# Altium schematic sheet 0228_GPU DDI_ A,B,C,D.SchDoc (continued)
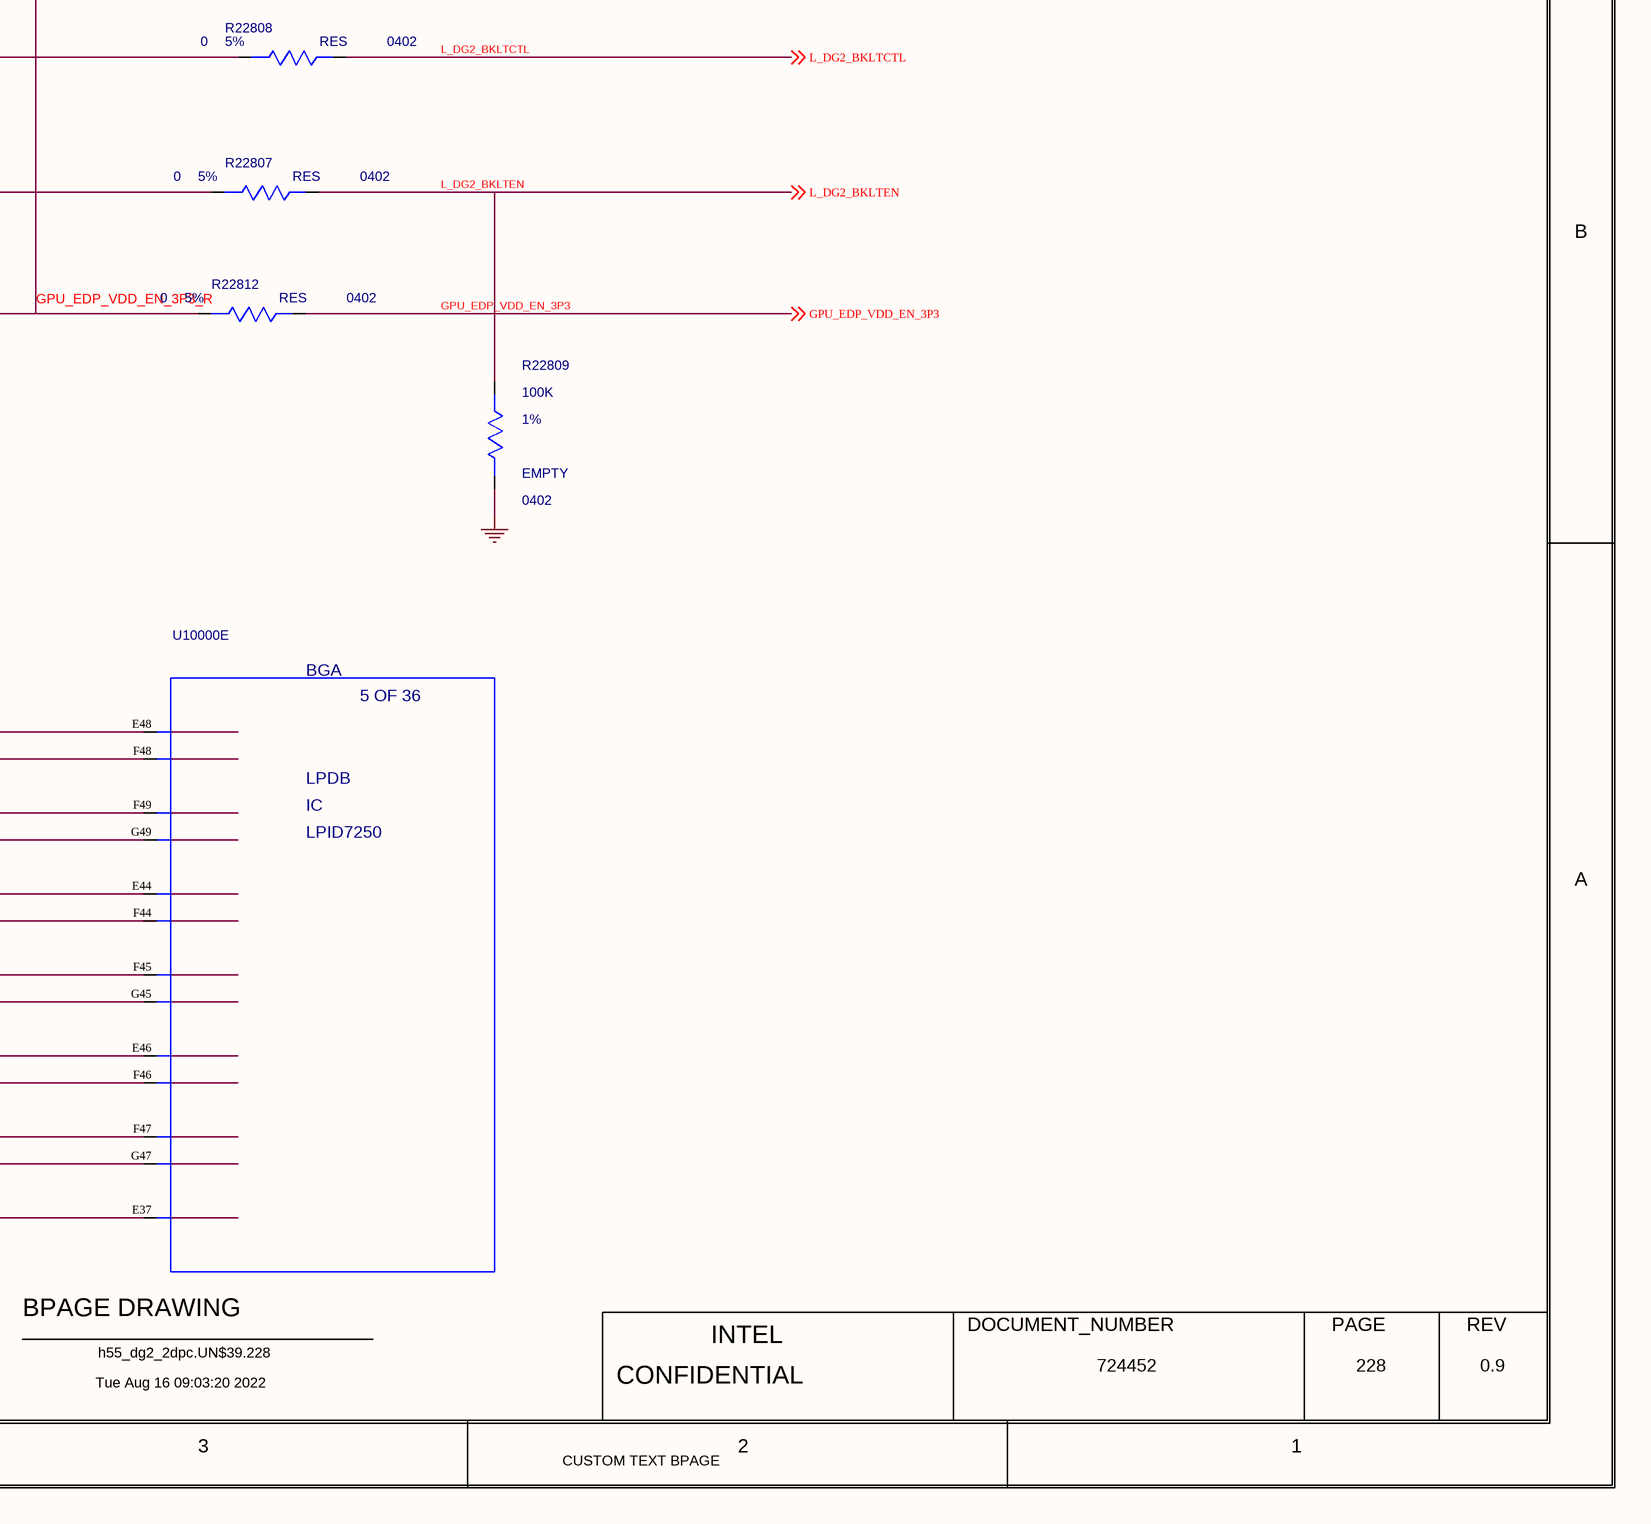
[diagram p5: 0228_GPU DDI_ A,B,C,D.SchDoc, bottom right]

## Parts
C22801  0.1uF  MATERIAL: EMPTY  PACK_TYPE: 0402  TOLERANCE: 10%  VOLTAGE: 25V  [CTK2_SM0402_1050X550_MA]
C22802  0.1uF  MATERIAL: EMPTY  PACK_TYPE: 0402  TOLERANCE: 10%  VOLTAGE: 25V  [CTK2_SM0402_1050X550_MA]
C22805  0.1uF  MATERIAL: EMPTY  PACK_TYPE: 0402  TOLERANCE: 10%  VOLTAGE: 25V  [CTK2_SM0402_1050X550_MA]
Q22801  RV1C002UNT2CL  PART_NUMBER: H76653-001  [CTK2_LCC3_850X650_350_MA]
Q22802  RV1C002UNT2CL  PART_NUMBER: H76653-001  [CTK2_LCC3_850X650_350_MA]
Q22803  RV1C002UNT2CL  PART_NUMBER: H76653-001  [CTK2_LCC3_850X650_350_MA]
R22802  2.2K  MATERIAL: CHIP  PACK_TYPE: 0402  PART_NUMBER: A93549-017  TOLERANCE: 5%  [SMR0402IA]
R22803  2.2K  MATERIAL: CHIP  PACK_TYPE: 0402  TOLERANCE: 5%  [SMR0402IA]
R22807  0  MATERIAL: RES  PACK_TYPE: 0402  TOLERANCE: 5%  [CTK2_SM0402_1100X550_MA]
R22808  0  MATERIAL: RES  PACK_TYPE: 0402  TOLERANCE: 5%  [CTK2_SM0402_1100X550_MA]
R22809  100K  MATERIAL: EMPTY  PACK_TYPE: 0402  TOLERANCE: 1%  [CTK2_SM0402_1100X550_MA]
R22810  2.2K  MATERIAL: CHIP  PACK_TYPE: 0402  TOLERANCE: 5%  [SMR0402IA]
R22811  2.2K  MATERIAL: CHIP  PACK_TYPE: 0402  TOLERANCE: 5%  [SMR0402IA]
R22812  0  MATERIAL: RES  PACK_TYPE: 0402  TOLERANCE: 5%  [CTK2_SM0402_1100X550_MA]
R22813  0  MATERIAL: RES  PACK_TYPE: 0402  TOLERANCE: 5%  [CTK2_SM0402_1100X550_MA]
R22814  0  MATERIAL: RES  PACK_TYPE: 0402  TOLERANCE: 5%  [CTK2_SM0402_1100X550_MA]
R22815  0  MATERIAL: RES  PACK_TYPE: 0402  TOLERANCE: 5%  [CTK2_SM0402_1100X550_MA]
R22816  0  MATERIAL: RES  PACK_TYPE: 0402  PART_NUMBER: A93549-001  TOLERANCE: 5%  WATTAGE: 0.0625W  [CTK2_SM0402_1100X550_MA]
R22817  2.2K  MATERIAL: CHIP  PACK_TYPE: 0402  TOLERANCE: 5%  [SMR0402IA]
R22818  2.2K  MATERIAL: CHIP  PACK_TYPE: 0402  TOLERANCE: 5%  [SMR0402IA]
R22819  0  MATERIAL: EMPTY  PACK_TYPE: 0402  PART_NUMBER: H75801-001  TOLERANCE: 5%  WATTAGE: 0.0625W  [CTK2_SM0402_1100X550_MA]
R22820  0  MATERIAL: RES  PACK_TYPE: 0402  PART_NUMBER: A93549-001  TOLERANCE: 5%  WATTAGE: 0.0625W  [CTK2_SM0402_1100X550_MA]
U10000  PART_NUMBER: LPID7250  PACK_TYPE: BGA  MATERIAL: IC  FP_TECH: LPDB  [CLPDB_BGA2660_DG2_SVC_512_LP7250_MA]  (hidden comment: DG2_IP_NB_SKU1_SKU2_SKU3_EXT)  (parts B,C,D,E of 36)

## Nets
+V1P8S_GPU: R22802.1(A) R22803.1(A) R22816.1(A) R22818.1(A)
+V3P3A: R22820.1(A)
+V3P3S: R22819.1(A)
GND: C22801.2(B) C22802.2(B) C22805.2(B) R22809.2(B)
DDIB_AUX_DN_NC: U10000.J51(DDIB_AUX_N)
DDIB_AUX_DP_NC: U10000.J52(DDIB_AUX_P)
DDID_I2C_CLK_NC: U10000.F49(DDCD_SCL)
DDID_I2C_DAT_NC: U10000.G49(DDCD_SDA)
EDP_BKLT_CTRL_LS_R: Q22803.3(D) R22808.1(A) R22810.2(B)
EDP_BKLT_EN_LS_R: Q22802.3(D) R22807.1(A) R22811.2(B)
EDP_DG2_AUX_DN: U10000.K56(DDIA_AUX_N) ; off-sheet EDP_DG2_AUX_DN
EDP_DG2_AUX_DP: U10000.K57(DDIA_AUX_P) ; off-sheet EDP_DG2_AUX_DP
EDP_DG2_TX0_DN: U10000.J55(DDIA_TXN0) ; off-sheet EDP_DG2_TX0_DN
EDP_DG2_TX0_DP: U10000.J56(DDIA_TXP0) ; off-sheet EDP_DG2_TX0_DP
EDP_DG2_TX1_DN: U10000.H56(DDIA_TXN1) ; off-sheet EDP_DG2_TX1_DN
EDP_DG2_TX1_DP: U10000.H57(DDIA_TXP1) ; off-sheet EDP_DG2_TX1_DP
EDP_DG2_TX2_DN: U10000.G55(DDIA_TXN2) ; off-sheet EDP_DG2_TX2_DN
EDP_DG2_TX2_DP: U10000.G56(DDIA_TXP2) ; off-sheet EDP_DG2_TX2_DP
EDP_DG2_TX3_DN: U10000.F56(DDIA_TXN3) ; off-sheet EDP_DG2_TX3_DN
EDP_DG2_TX3_DP: U10000.F57(DDIA_TXP3) ; off-sheet EDP_DG2_TX3_DP
GPU_DDIA_I2C_CLK_NC: U10000.E56(DDCA_SCL)
GPU_DDIA_I2C_DAT_NC: U10000.E55(DDCA_SDA)
GPU_DDIB_DP_HPDB_N: U10000.B37(DP_HPDB#) ; off-sheet GPU_DDIB_DP_HPDB_N
GPU_DDIB_LANE0_DN: U10000.H52(DDIB_TXN0) ; off-sheet GPU_DDIB_LANE0_DN
GPU_DDIB_LANE0_DP: U10000.H53(DDIB_TXP0) ; off-sheet GPU_DDIB_LANE0_DP
GPU_DDIB_LANE1_DN: U10000.G51(DDIB_TXN1) ; off-sheet GPU_DDIB_LANE1_DN
GPU_DDIB_LANE1_DP: U10000.G52(DDIB_TXP1) ; off-sheet GPU_DDIB_LANE1_DP
GPU_DDIB_LANE2_DN: U10000.F52(DDIB_TXN2) ; off-sheet GPU_DDIB_LANE2_DN
GPU_DDIB_LANE2_DP: U10000.F53(DDIB_TXP2) ; off-sheet GPU_DDIB_LANE2_DP
GPU_DDIB_LANE3_DN: U10000.E51(DDIB_TXN3) ; off-sheet GPU_DDIB_LANE3_DN
GPU_DDIB_LANE3_DP: U10000.E52(DDIB_TXP3) ; off-sheet GPU_DDIB_LANE3_DP
GPU_DDIB_SCL: U10000.K52(DDCB_SCL) ; off-sheet GPU_DDIB_SCL
GPU_DDIB_SDA: U10000.K53(DDCB_SDA) ; off-sheet GPU_DDIB_SDA
GPU_DDIC_DP_HPD_N: U10000.C37(DP_HPDC#) ; off-sheet GPU_DDIC_DP_HPD_N
GPU_DDIC_DPIN2_AUX_DN: U10000.B53(DDIC_AUX_N) ; off-sheet GPU_DDIC_DPIN2_AUX_DN
GPU_DDIC_DPIN2_AUX_DP: U10000.A53(DDIC_AUX_P) ; off-sheet GPU_DDIC_DPIN2_AUX_DP
GPU_DDIC_DPIN2_LANE0_DN: U10000.C52(DDIC_TXN0) ; off-sheet GPU_DDIC_DPIN2_LANE0_DN
GPU_DDIC_DPIN2_LANE0_DP: U10000.B52(DDIC_TXP0) ; off-sheet GPU_DDIC_DPIN2_LANE0_DP
GPU_DDIC_DPIN2_LANE1_DN: U10000.B51(DDIC_TXN1) ; off-sheet GPU_DDIC_DPIN2_LANE1_DN
GPU_DDIC_DPIN2_LANE1_DP: U10000.A51(DDIC_TXP1) ; off-sheet GPU_DDIC_DPIN2_LANE1_DP
GPU_DDIC_DPIN2_LANE2_DN: U10000.C50(DDIC_TXN2) ; off-sheet GPU_DDIC_DPIN2_LANE2_DN
GPU_DDIC_DPIN2_LANE2_DP: U10000.B50(DDIC_TXP2) ; off-sheet GPU_DDIC_DPIN2_LANE2_DP
GPU_DDIC_DPIN2_LANE3_DN: U10000.B49(DDIC_TXN3) ; off-sheet GPU_DDIC_DPIN2_LANE3_DN
GPU_DDIC_DPIN2_LANE3_DP: U10000.A49(DDIC_TXP3) ; off-sheet GPU_DDIC_DPIN2_LANE3_DP
GPU_DDIC_I2C_CLK_NC: U10000.B48(DDCC_SCL)
GPU_DDIC_I2C_DAT_NC: U10000.C48(DDCC_SDA)
GPU_DDID_DP_HPD_N: U10000.E37(DP_HPDD#) ; off-sheet GPU_DDID_DP_HPD_N
GPU_DDID_DPIN1_AUX_DN: U10000.F48(DDID_AUX_N) ; off-sheet GPU_DDID_DPIN1_AUX_DN
GPU_DDID_DPIN1_AUX_DP: U10000.E48(DDID_AUX_P) ; off-sheet GPU_DDID_DPIN1_AUX_DP
GPU_DDID_DPIN1_LANE0_DN: U10000.G47(DDID_TXN0) ; off-sheet GPU_DDID_DPIN1_LANE0_DN
GPU_DDID_DPIN1_LANE0_DP: U10000.F47(DDID_TXP0) ; off-sheet GPU_DDID_DPIN1_LANE0_DP
GPU_DDID_DPIN1_LANE1_DN: U10000.F46(DDID_TXN1) ; off-sheet GPU_DDID_DPIN1_LANE1_DN
GPU_DDID_DPIN1_LANE1_DP: U10000.E46(DDID_TXP1) ; off-sheet GPU_DDID_DPIN1_LANE1_DP
GPU_DDID_DPIN1_LANE2_DN: U10000.G45(DDID_TXN2) ; off-sheet GPU_DDID_DPIN1_LANE2_DN
GPU_DDID_DPIN1_LANE2_DP: U10000.F45(DDID_TXP2) ; off-sheet GPU_DDID_DPIN1_LANE2_DP
GPU_DDID_DPIN1_LANE3_DN: U10000.F44(DDID_TXN3) ; off-sheet GPU_DDID_DPIN1_LANE3_DN
GPU_DDID_DPIN1_LANE3_DP: U10000.E44(DDID_TXP3) ; off-sheet GPU_DDID_DPIN1_LANE3_DP
GPU_DISP_UTILS0_NC: U10000.G38(DISP_UTILS0)
GPU_DISP_UTILS1_NC: U10000.H38(DISP_UTILS1)
GPU_EDP_BKLT_CNTRL_FET: Q22801.1(G) Q22802.1(G) Q22803.1(G) R22816.2(B)
GPU_EDP_BKLT_CTRL: C22801.1(A) R22802.2(B) R22814.1(A) ; off-sheet GPU_EDP_BKLT_CTRL
GPU_EDP_BKLT_CTRL_R: Q22803.2(S) R22814.2(B)
GPU_EDP_BKLT_EN: C22802.1(A) R22803.2(B) R22815.1(A) ; off-sheet GPU_EDP_BKLT_EN
GPU_EDP_BKLT_EN_R: Q22802.2(S) R22815.2(B)
GPU_EDP_HPD: U10000.A37(DP_HPDA#) ; off-sheet GPU_EDP_HPD
GPU_EDP_VDD_EN: C22805.1(A) R22813.1(A) R22818.2(B) ; off-sheet GPU_EDP_VDD_EN
GPU_EDP_VDD_EN_3P3: R22812.2(B) ; off-sheet GPU_EDP_VDD_EN_3P3
GPU_EDP_VDD_EN_3P3_R: Q22801.3(D) R22812.1(A) R22817.2(B)
GPU_EDP_VDD_EN_R: Q22801.2(S) R22813.2(B)
L_DG2_BKLTCTL: R22808.2(B) ; off-sheet L_DG2_BKLTCTL
L_DG2_BKLTEN: R22807.2(B) R22809.1(A) ; off-sheet L_DG2_BKLTEN
UNNAMED_399_RES_I467_A: R22810.1(A) R22811.1(A) R22817.1(A) R22819.2(B) R22820.2(B)

Not connected (* = marked no-connect by the designer): U10000 F39(PANEL_VDDEN) G39(PANEL_BKLTCTL) H39(PANEL_BKLTEN)

## Notes on the sheet
- <XR_PAGE_TITLE>
- 8
- 7
- 6
- 5
- 4
- 3
- 2
- 1
- MODULE REV DETAILS
- GPU DDI: A,B,C,D
- MODULE NAME
- REV
- DATE
- D
- C
- B
- A
- BPAGE DRAWING
- INTEL
- DOCUMENT_NUMBER
- PAGE
- Tue Aug 16 09:03:20 2022
- h55_dg2_2dpc.UN$39.228
- CONFIDENTIAL
- 724452
- 228
- 0.9
- CUSTOM TEXT BPAGE
- (in symbol DG2_IP_NB_SKU1_SKU2_SKU3_EXT, part B) 2 OF 36
- (in symbol DG2_IP_NB_SKU1_SKU2_SKU3_EXT, part C) 3 OF 36
- (in symbol DG2_IP_NB_SKU1_SKU2_SKU3_EXT, part D) 4 OF 36
- (in symbol DG2_IP_NB_SKU1_SKU2_SKU3_EXT, part E) 5 OF 36

## Library data of the parts
C22801 = C_CAP: PART_NUMBER: G27060-002; CDS_PHYS_PART_NAME: C_CAP_0402-G27060-002,EMPTY,0.1UF,25V,10%,TK2,GENERIC; CDS_LMAN_SYM_OUTLINE: -50,50,50,-50; FP_TECH: TK2; IP: GENERIC; ROOM: NONE; OriginalSymbolOrigin: (-50,25); XY: (3650,1950); VER: 1; ROT: 0; PHYS_PAGE: 228; LOCATION: C22801; DRAWING: @RVP1_ADL_SB_ADP_S_DDR5_SODIMM_2DPC_LIB.H55_DG2_2DPC(SCH_1):PAGE399; CDS_LIB: c_discrete; VARIANT: ?; PCB Footprint: CTK2_SM0402_1050X550_MA; CHIPS_PART_NAME: C_CAP; CDS_PART_NAME: C_CAP_0402-G27060-002,EMPTY,0.1UF,25V,10%,TK2,GENERIC; CDS_LOCATION: C22801
C22802 = C_CAP: PART_NUMBER: G27060-002; CDS_PHYS_PART_NAME: C_CAP_0402-G27060-002,EMPTY,0.1UF,25V,10%,TK2,GENERIC; CDS_LMAN_SYM_OUTLINE: -50,50,50,-50; FP_TECH: TK2; IP: GENERIC; ROOM: NONE; OriginalSymbolOrigin: (-50,25); XY: (3925,1925); VER: 1; ROT: 0; PHYS_PAGE: 228; LOCATION: C22802; DRAWING: @RVP1_ADL_SB_ADP_S_DDR5_SODIMM_2DPC_LIB.H55_DG2_2DPC(SCH_1):PAGE399; CDS_LIB: c_discrete; VARIANT: ?; PCB Footprint: CTK2_SM0402_1050X550_MA; CHIPS_PART_NAME: C_CAP; CDS_PART_NAME: C_CAP_0402-G27060-002,EMPTY,0.1UF,25V,10%,TK2,GENERIC; CDS_LOCATION: C22802
C22805 = C_CAP: PART_NUMBER: G27060-002; CDS_PHYS_PART_NAME: C_CAP_0402-G27060-002,EMPTY,0.1UF,25V,10%,TK2,GENERIC; CDS_LMAN_SYM_OUTLINE: -50,50,50,-50; FP_TECH: TK2; IP: GENERIC; ROOM: NONE; OriginalSymbolOrigin: (-50,25); XY: (4250,1925); VER: 1; ROT: 0; PHYS_PAGE: 228; LOCATION: C22805; DRAWING: @RVP1_ADL_SB_ADP_S_DDR5_SODIMM_2DPC_LIB.H55_DG2_2DPC(SCH_1):PAGE399; CDS_LIB: c_discrete; VARIANT: ?; PCB Footprint: CTK2_SM0402_1050X550_MA; CHIPS_PART_NAME: C_CAP; CDS_PART_NAME: C_CAP_0402-G27060-002,EMPTY,0.1UF,25V,10%,TK2,GENERIC; CDS_LOCATION: C22805
Q22801 = C_MOSFET_N_ESD: CDS_PHYS_PART_NAME: C_MOSFET_N_ESD_LCC-H76653-001,MFET,RV1C002UNT2CL,TK2,GENERIC; CDS_LMAN_SYM_OUTLINE: -150,150,150,-150; FP_TECH: TK2; IP: GENERIC; MATERIAL: MFET; PACK_TYPE: LCC; ROOM: NONE; OriginalSymbolOrigin: (-150,150); XY: (5800,2150); VER: 1; ROT: 5; PHYS_PAGE: 228; LOCATION: Q22801; DRAWING: @RVP1_ADL_SB_ADP_S_DDR5_SODIMM_2DPC_LIB.H55_DG2_2DPC(SCH_1):PAGE399; CDS_LIB: local; VARIANT: ?; PCB Footprint: CTK2_LCC3_850X650_350_MA; CHIPS_PART_NAME: C_MOSFET_N_ESD; CDS_PART_NAME: C_MOSFET_N_ESD_LCC-H76653-001,MFET,RV1C002UNT2CL,TK2,GENERIC; CDS_LOCATION: Q22801
Q22802 = C_MOSFET_N_ESD: CDS_PHYS_PART_NAME: C_MOSFET_N_ESD_LCC-H76653-001,MFET,RV1C002UNT2CL,TK2,GENERIC; CDS_LMAN_SYM_OUTLINE: -150,150,150,-150; FP_TECH: TK2; IP: GENERIC; MATERIAL: MFET; PACK_TYPE: LCC; ROOM: NONE; OriginalSymbolOrigin: (-150,150); XY: (6000,2375); VER: 1; ROT: 5; PHYS_PAGE: 228; LOCATION: Q22802; DRAWING: @RVP1_ADL_SB_ADP_S_DDR5_SODIMM_2DPC_LIB.H55_DG2_2DPC(SCH_1):PAGE399; CDS_LIB: local; VARIANT: ?; PCB Footprint: CTK2_LCC3_850X650_350_MA; CHIPS_PART_NAME: C_MOSFET_N_ESD; CDS_PART_NAME: C_MOSFET_N_ESD_LCC-H76653-001,MFET,RV1C002UNT2CL,TK2,GENERIC; CDS_LOCATION: Q22802
Q22803 = C_MOSFET_N_ESD: CDS_PHYS_PART_NAME: C_MOSFET_N_ESD_LCC-H76653-001,MFET,RV1C002UNT2CL,TK2,GENERIC; CDS_LMAN_SYM_OUTLINE: -150,150,150,-150; FP_TECH: TK2; IP: GENERIC; MATERIAL: MFET; PACK_TYPE: LCC; ROOM: NONE; OriginalSymbolOrigin: (-150,150); XY: (6175,2625); VER: 1; ROT: 5; PHYS_PAGE: 228; LOCATION: Q22803; DRAWING: @RVP1_ADL_SB_ADP_S_DDR5_SODIMM_2DPC_LIB.H55_DG2_2DPC(SCH_1):PAGE399; CDS_LIB: local; VARIANT: ?; PCB Footprint: CTK2_LCC3_850X650_350_MA; CHIPS_PART_NAME: C_MOSFET_N_ESD; CDS_PART_NAME: C_MOSFET_N_ESD_LCC-H76653-001,MFET,RV1C002UNT2CL,TK2,GENERIC; CDS_LOCATION: Q22803
R22802 = RES: CDS_PHYS_PART_NAME: RES_0402-A93549-017,CHIP,2.2K,5%,1/16W,LPDB,GENERIC; WATTAGE: 1/16W; OriginalSymbolOrigin: (-25,75); XY: (4125,2875); VER: 2; ROT: 0; PHYS_PAGE: 228; LOCATION: R22802; IP: GENERIC; FP_TECH: LPDB; FIN: PCH; DRAWING: @RVP1_ADL_SB_ADP_S_DDR5_SODIMM_2DPC_LIB.H55_DG2_2DPC(SCH_1):PAGE399; CDS_LIB: discrete; PCB Footprint: SMR0402IA; CHIPS_PART_NAME: RES; CDS_PART_NAME: RES_0402-A93549-017,CHIP,2.2K,5%,1/16W,LPDB,GENERIC; CDS_LOCATION: R22802; ASI_MODEL: A93549-017
R22803 = RES: PART_NUMBER: A93549-017; CDS_PHYS_PART_NAME: RES_0402-A93549-017,CHIP,2.2K,5%,1/16W,LPDB,GENERIC; WATTAGE: 1/16W; OriginalSymbolOrigin: (-25,75); XY: (4350,2875); VER: 2; ROT: 0; PHYS_PAGE: 228; LOCATION: R22803; IP: GENERIC; FP_TECH: LPDB; FIN: PCH; DRAWING: @RVP1_ADL_SB_ADP_S_DDR5_SODIMM_2DPC_LIB.H55_DG2_2DPC(SCH_1):PAGE399; CDS_LIB: discrete; PCB Footprint: SMR0402IA; CHIPS_PART_NAME: RES; CDS_PART_NAME: RES_0402-A93549-017,CHIP,2.2K,5%,1/16W,LPDB,GENERIC; CDS_LOCATION: R22803; ASI_MODEL: A93549-017
R22807 = C_RES#1: PART_NUMBER: A93549-001; CHIPS_PART_NAME: C_RES; CDS_PHYS_PART_NAME: C_RES_0402-A93549-001,RES,0,5%,0.0625W,TK2,GENERIC; CDS_LMAN_SYM_OUTLINE: -50,50,50,-50; FP_TECH: TK2; IP: GENERIC; ROOM: NONE; WATTAGE: 0.0625W; OriginalSymbolOrigin: (-75,25); XY: (7525,2375); VER: 1; PHYS_PAGE: 228; LOCATION: R22807; DRAWING: @RVP1_ADL_SB_ADP_S_DDR5_SODIMM_2DPC_LIB.H55_DG2_2DPC(SCH_1):PAGE399; CDS_LIB: c_discrete; VARIANT: ?; PCB Footprint: CTK2_SM0402_1100X550_MA; ROT: 0; CDS_PART_NAME: C_RES_0402-A93549-001,RES,0,5%,0.0625W,TK2,GENERIC; CDS_LOCATION: R22807
R22808 = C_RES#1: PART_NUMBER: A93549-001; CHIPS_PART_NAME: C_RES; CDS_PHYS_PART_NAME: C_RES_0402-A93549-001,RES,0,5%,0.0625W,TK2,GENERIC; CDS_LMAN_SYM_OUTLINE: -50,50,50,-50; FP_TECH: TK2; IP: GENERIC; ROOM: NONE; WATTAGE: 0.0625W; OriginalSymbolOrigin: (-75,25); XY: (7575,2625); VER: 1; PHYS_PAGE: 228; LOCATION: R22808; DRAWING: @RVP1_ADL_SB_ADP_S_DDR5_SODIMM_2DPC_LIB.H55_DG2_2DPC(SCH_1):PAGE399; CDS_LIB: c_discrete; VARIANT: ?; PCB Footprint: CTK2_SM0402_1100X550_MA; ROT: 0; CDS_PART_NAME: C_RES_0402-A93549-001,RES,0,5%,0.0625W,TK2,GENERIC; CDS_LOCATION: R22808
R22809 = C_RES: PART_NUMBER: A93548-128; CDS_PHYS_PART_NAME: C_RES_0402-A93548-128,EMPTY,100K,1%,0.0625W,TK2,GENERIC; CDS_LMAN_SYM_OUTLINE: -50,50,50,-50; FP_TECH: TK2; IP: GENERIC; ROOM: NONE; WATTAGE: 0.0625W; OriginalSymbolOrigin: (-25,75); XY: (7950,1925); VER: 2; ROT: 0; PHYS_PAGE: 228; LOCATION: R22809; DRAWING: @RVP1_ADL_SB_ADP_S_DDR5_SODIMM_2DPC_LIB.H55_DG2_2DPC(SCH_1):PAGE399; CDS_LIB: c_discrete; VARIANT: ?; PCB Footprint: CTK2_SM0402_1100X550_MA; CHIPS_PART_NAME: C_RES; CDS_PART_NAME: C_RES_0402-A93548-128,EMPTY,100K,1%,0.0625W,TK2,GENERIC; CDS_LOCATION: R22809
R22810 = RES: PART_NUMBER: A93549-017; CDS_PHYS_PART_NAME: RES_0402-A93549-017,CHIP,2.2K,5%,1/16W,LPDB,GENERIC; WATTAGE: 1/16W; OriginalSymbolOrigin: (-25,75); XY: (6475,2850); VER: 2; ROT: 0; PHYS_PAGE: 228; LOCATION: R22810; IP: GENERIC; FP_TECH: LPDB; FIN: PCH; DRAWING: @RVP1_ADL_SB_ADP_S_DDR5_SODIMM_2DPC_LIB.H55_DG2_2DPC(SCH_1):PAGE399; CDS_LIB: discrete; PCB Footprint: SMR0402IA; CHIPS_PART_NAME: RES; CDS_PART_NAME: RES_0402-A93549-017,CHIP,2.2K,5%,1/16W,LPDB,GENERIC; CDS_LOCATION: R22810; ASI_MODEL: A93549-017
R22811 = RES: PART_NUMBER: A93549-017; CDS_PHYS_PART_NAME: RES_0402-A93549-017,CHIP,2.2K,5%,1/16W,LPDB,GENERIC; WATTAGE: 1/16W; OriginalSymbolOrigin: (-25,75); XY: (6775,2850); VER: 2; ROT: 0; PHYS_PAGE: 228; LOCATION: R22811; IP: GENERIC; FP_TECH: LPDB; FIN: PCH; DRAWING: @RVP1_ADL_SB_ADP_S_DDR5_SODIMM_2DPC_LIB.H55_DG2_2DPC(SCH_1):PAGE399; CDS_LIB: discrete; PCB Footprint: SMR0402IA; CHIPS_PART_NAME: RES; CDS_PART_NAME: RES_0402-A93549-017,CHIP,2.2K,5%,1/16W,LPDB,GENERIC; CDS_LOCATION: R22811; ASI_MODEL: A93549-017
R22812 = C_RES#1: PART_NUMBER: A93549-001; CHIPS_PART_NAME: C_RES; CDS_PHYS_PART_NAME: C_RES_0402-A93549-001,RES,0,5%,0.0625W,TK2,GENERIC; CDS_LMAN_SYM_OUTLINE: -50,50,50,-50; FP_TECH: TK2; IP: GENERIC; ROOM: NONE; WATTAGE: 0.0625W; OriginalSymbolOrigin: (-75,25); XY: (7500,2150); VER: 1; PHYS_PAGE: 228; LOCATION: R22812; DRAWING: @RVP1_ADL_SB_ADP_S_DDR5_SODIMM_2DPC_LIB.H55_DG2_2DPC(SCH_1):PAGE399; CDS_LIB: c_discrete; VARIANT: ?; PCB Footprint: CTK2_SM0402_1100X550_MA; ROT: 0; CDS_PART_NAME: C_RES_0402-A93549-001,RES,0,5%,0.0625W,TK2,GENERIC; CDS_LOCATION: R22812
R22813 = C_RES#1: PART_NUMBER: A93549-001; CHIPS_PART_NAME: C_RES; CDS_PHYS_PART_NAME: C_RES_0402-A93549-001,RES,0,5%,0.0625W,TK2,GENERIC; CDS_LMAN_SYM_OUTLINE: -50,50,50,-50; FP_TECH: TK2; IP: GENERIC; ROOM: NONE; WATTAGE: 0.0625W; OriginalSymbolOrigin: (-75,25); XY: (4675,2150); VER: 1; PHYS_PAGE: 228; LOCATION: R22813; DRAWING: @RVP1_ADL_SB_ADP_S_DDR5_SODIMM_2DPC_LIB.H55_DG2_2DPC(SCH_1):PAGE399; CDS_LIB: c_discrete; VARIANT: ?; PCB Footprint: CTK2_SM0402_1100X550_MA; ROT: 0; CDS_PART_NAME: C_RES_0402-A93549-001,RES,0,5%,0.0625W,TK2,GENERIC; CDS_LOCATION: R22813
R22814 = C_RES#1: PART_NUMBER: A93549-001; CHIPS_PART_NAME: C_RES; CDS_PHYS_PART_NAME: C_RES_0402-A93549-001,RES,0,5%,0.0625W,TK2,GENERIC; CDS_LMAN_SYM_OUTLINE: -50,50,50,-50; FP_TECH: TK2; IP: GENERIC; ROOM: NONE; WATTAGE: 0.0625W; OriginalSymbolOrigin: (-75,25); XY: (4700,2625); VER: 1; PHYS_PAGE: 228; LOCATION: R22814; DRAWING: @RVP1_ADL_SB_ADP_S_DDR5_SODIMM_2DPC_LIB.H55_DG2_2DPC(SCH_1):PAGE399; CDS_LIB: c_discrete; VARIANT: ?; PCB Footprint: CTK2_SM0402_1100X550_MA; ROT: 0; CDS_PART_NAME: C_RES_0402-A93549-001,RES,0,5%,0.0625W,TK2,GENERIC; CDS_LOCATION: R22814
R22815 = C_RES#1: PART_NUMBER: A93549-001; CHIPS_PART_NAME: C_RES; CDS_PHYS_PART_NAME: C_RES_0402-A93549-001,RES,0,5%,0.0625W,TK2,GENERIC; CDS_LMAN_SYM_OUTLINE: -50,50,50,-50; FP_TECH: TK2; IP: GENERIC; ROOM: NONE; WATTAGE: 0.0625W; OriginalSymbolOrigin: (-75,25); XY: (4700,2375); VER: 1; PHYS_PAGE: 228; LOCATION: R22815; DRAWING: @RVP1_ADL_SB_ADP_S_DDR5_SODIMM_2DPC_LIB.H55_DG2_2DPC(SCH_1):PAGE399; CDS_LIB: c_discrete; VARIANT: ?; PCB Footprint: CTK2_SM0402_1100X550_MA; ROT: 0; CDS_PART_NAME: C_RES_0402-A93549-001,RES,0,5%,0.0625W,TK2,GENERIC; CDS_LOCATION: R22815
R22816 = C_RES: CDS_PHYS_PART_NAME: C_RES_0402-A93549-001,RES,0,5%,0.0625W,TK2,GENERIC; CDS_LMAN_SYM_OUTLINE: -50,50,50,-50; FP_TECH: TK2; IP: GENERIC; ROOM: NONE; OriginalSymbolOrigin: (-25,75); XY: (5750,3050); VER: 2; PHYS_PAGE: 228; LOCATION: R22816; DRAWING: @RVP1_ADL_SB_ADP_S_DDR5_SODIMM_2DPC_LIB.H55_DG2_2DPC(SCH_1):PAGE399; CDS_LIB: c_discrete; VARIANT: ?; PCB Footprint: CTK2_SM0402_1100X550_MA; ROT: 0; CHIPS_PART_NAME: C_RES; CDS_PART_NAME: C_RES_0402-A93549-001,RES,0,5%,0.0625W,TK2,GENERIC; CDS_LOCATION: R22816
R22817 = RES: PART_NUMBER: A93549-017; CDS_PHYS_PART_NAME: RES_0402-A93549-017,CHIP,2.2K,5%,1/16W,LPDB,GENERIC; WATTAGE: 1/16W; OriginalSymbolOrigin: (-25,75); XY: (7100,2850); VER: 2; ROT: 0; PHYS_PAGE: 228; LOCATION: R22817; IP: GENERIC; FP_TECH: LPDB; FIN: PCH; DRAWING: @RVP1_ADL_SB_ADP_S_DDR5_SODIMM_2DPC_LIB.H55_DG2_2DPC(SCH_1):PAGE399; CDS_LIB: discrete; PCB Footprint: SMR0402IA; CHIPS_PART_NAME: RES; CDS_PART_NAME: RES_0402-A93549-017,CHIP,2.2K,5%,1/16W,LPDB,GENERIC; CDS_LOCATION: R22817; ASI_MODEL: A93549-017
R22818 = RES: PART_NUMBER: A93549-017; CDS_PHYS_PART_NAME: RES_0402-A93549-017,CHIP,2.2K,5%,1/16W,LPDB,GENERIC; WATTAGE: 1/16W; OriginalSymbolOrigin: (-25,75); XY: (4525,2875); VER: 2; ROT: 0; PHYS_PAGE: 228; LOCATION: R22818; IP: GENERIC; FP_TECH: LPDB; FIN: PCH; DRAWING: @RVP1_ADL_SB_ADP_S_DDR5_SODIMM_2DPC_LIB.H55_DG2_2DPC(SCH_1):PAGE399; CDS_LIB: discrete; PCB Footprint: SMR0402IA; CHIPS_PART_NAME: RES; CDS_PART_NAME: RES_0402-A93549-017,CHIP,2.2K,5%,1/16W,LPDB,GENERIC; CDS_LOCATION: R22818; ASI_MODEL: A93549-017
R22819 = C_RES: CDS_PHYS_PART_NAME: C_RES_0402-H75801-001,EMPTY,0,5%,0.0625W,TK2,GENERIC; CDS_LMAN_SYM_OUTLINE: -50,50,50,-50; FP_TECH: TK2; IP: GENERIC; ROOM: NONE; OriginalSymbolOrigin: (-25,75); XY: (6550,3175); VER: 2; PHYS_PAGE: 228; LOCATION: R22819; DRAWING: @RVP1_ADL_SB_ADP_S_DDR5_SODIMM_2DPC_LIB.H55_DG2_2DPC(SCH_1):PAGE399; CDS_LIB: c_discrete; VARIANT: ?; PCB Footprint: CTK2_SM0402_1100X550_MA; ROT: 0; CHIPS_PART_NAME: C_RES; CDS_PART_NAME: C_RES_0402-H75801-001,EMPTY,0,5%,0.0625W,TK2,GENERIC; CDS_LOCATION: R22819
R22820 = C_RES: CDS_PHYS_PART_NAME: C_RES_0402-A93549-001,RES,0,5%,0.0625W,TK2,GENERIC; CDS_LMAN_SYM_OUTLINE: -50,50,50,-50; FP_TECH: TK2; IP: GENERIC; ROOM: NONE; OriginalSymbolOrigin: (-25,75); XY: (7050,3175); VER: 2; PHYS_PAGE: 228; LOCATION: R22820; DRAWING: @RVP1_ADL_SB_ADP_S_DDR5_SODIMM_2DPC_LIB.H55_DG2_2DPC(SCH_1):PAGE399; CDS_LIB: c_discrete; VARIANT: ?; PCB Footprint: CTK2_SM0402_1100X550_MA; ROT: 0; CHIPS_PART_NAME: C_RES; CDS_PART_NAME: C_RES_0402-A93549-001,RES,0,5%,0.0625W,TK2,GENERIC; CDS_LOCATION: R22820
U10000 = DG2_IP_NB_SKU1_SKU2_SKU3_EXT: MANUF: INTEL CORP; CDS_PHYS_PART_NAME: DG2_IP_NB_SKU1_SKU2_SKU3_EXT_BGA-LPID7250,IC,DG2_IP_NB_SKU1_SKUA; CDS_LMAN_SYM_OUTLINE: -300,850,300,-800; OriginalSymbolOrigin: (-325,850); CaptureCellPackProp: DG2_IP_NB_SKU1_SKU2_SKU3_EXTB; XY: (4050,3925); VER: 2; PHYS_PAGE: 228; MFG_PN: NONE; LOCATION: U10000; DRAWING: @RVP1_ADL_SB_ADP_S_DDR5_SODIMM_2DPC_LIB.H55_DG2_2DPC(SCH_1):PAGE399; CDS_LIB: rvp1_adl_sb_adp_s_ddr5_sodimm_2dpc_lib; BMAP_REV: 1.0; PCB Footprint: CLPDB_BGA2660_DG2_SVC_512_LP7250_MA; SEC_TYPE: BGA; ROT: 2; CHIPS_PART_NAME: DG2_IP_NB_SKU1_SKU2_SKU3_EXT; CDS_PART_NAME: DG2_IP_NB_SKU1_SKU2_SKU3_EXT_BGA-LPID7250,IC,DG2_IP_NB_SKU1_SKUA; CDS_LOCATION: U10000